# EasyEDA Pro project ProProject_Avaota Pi A_2024-03-25.epro, board 点位 (continued)
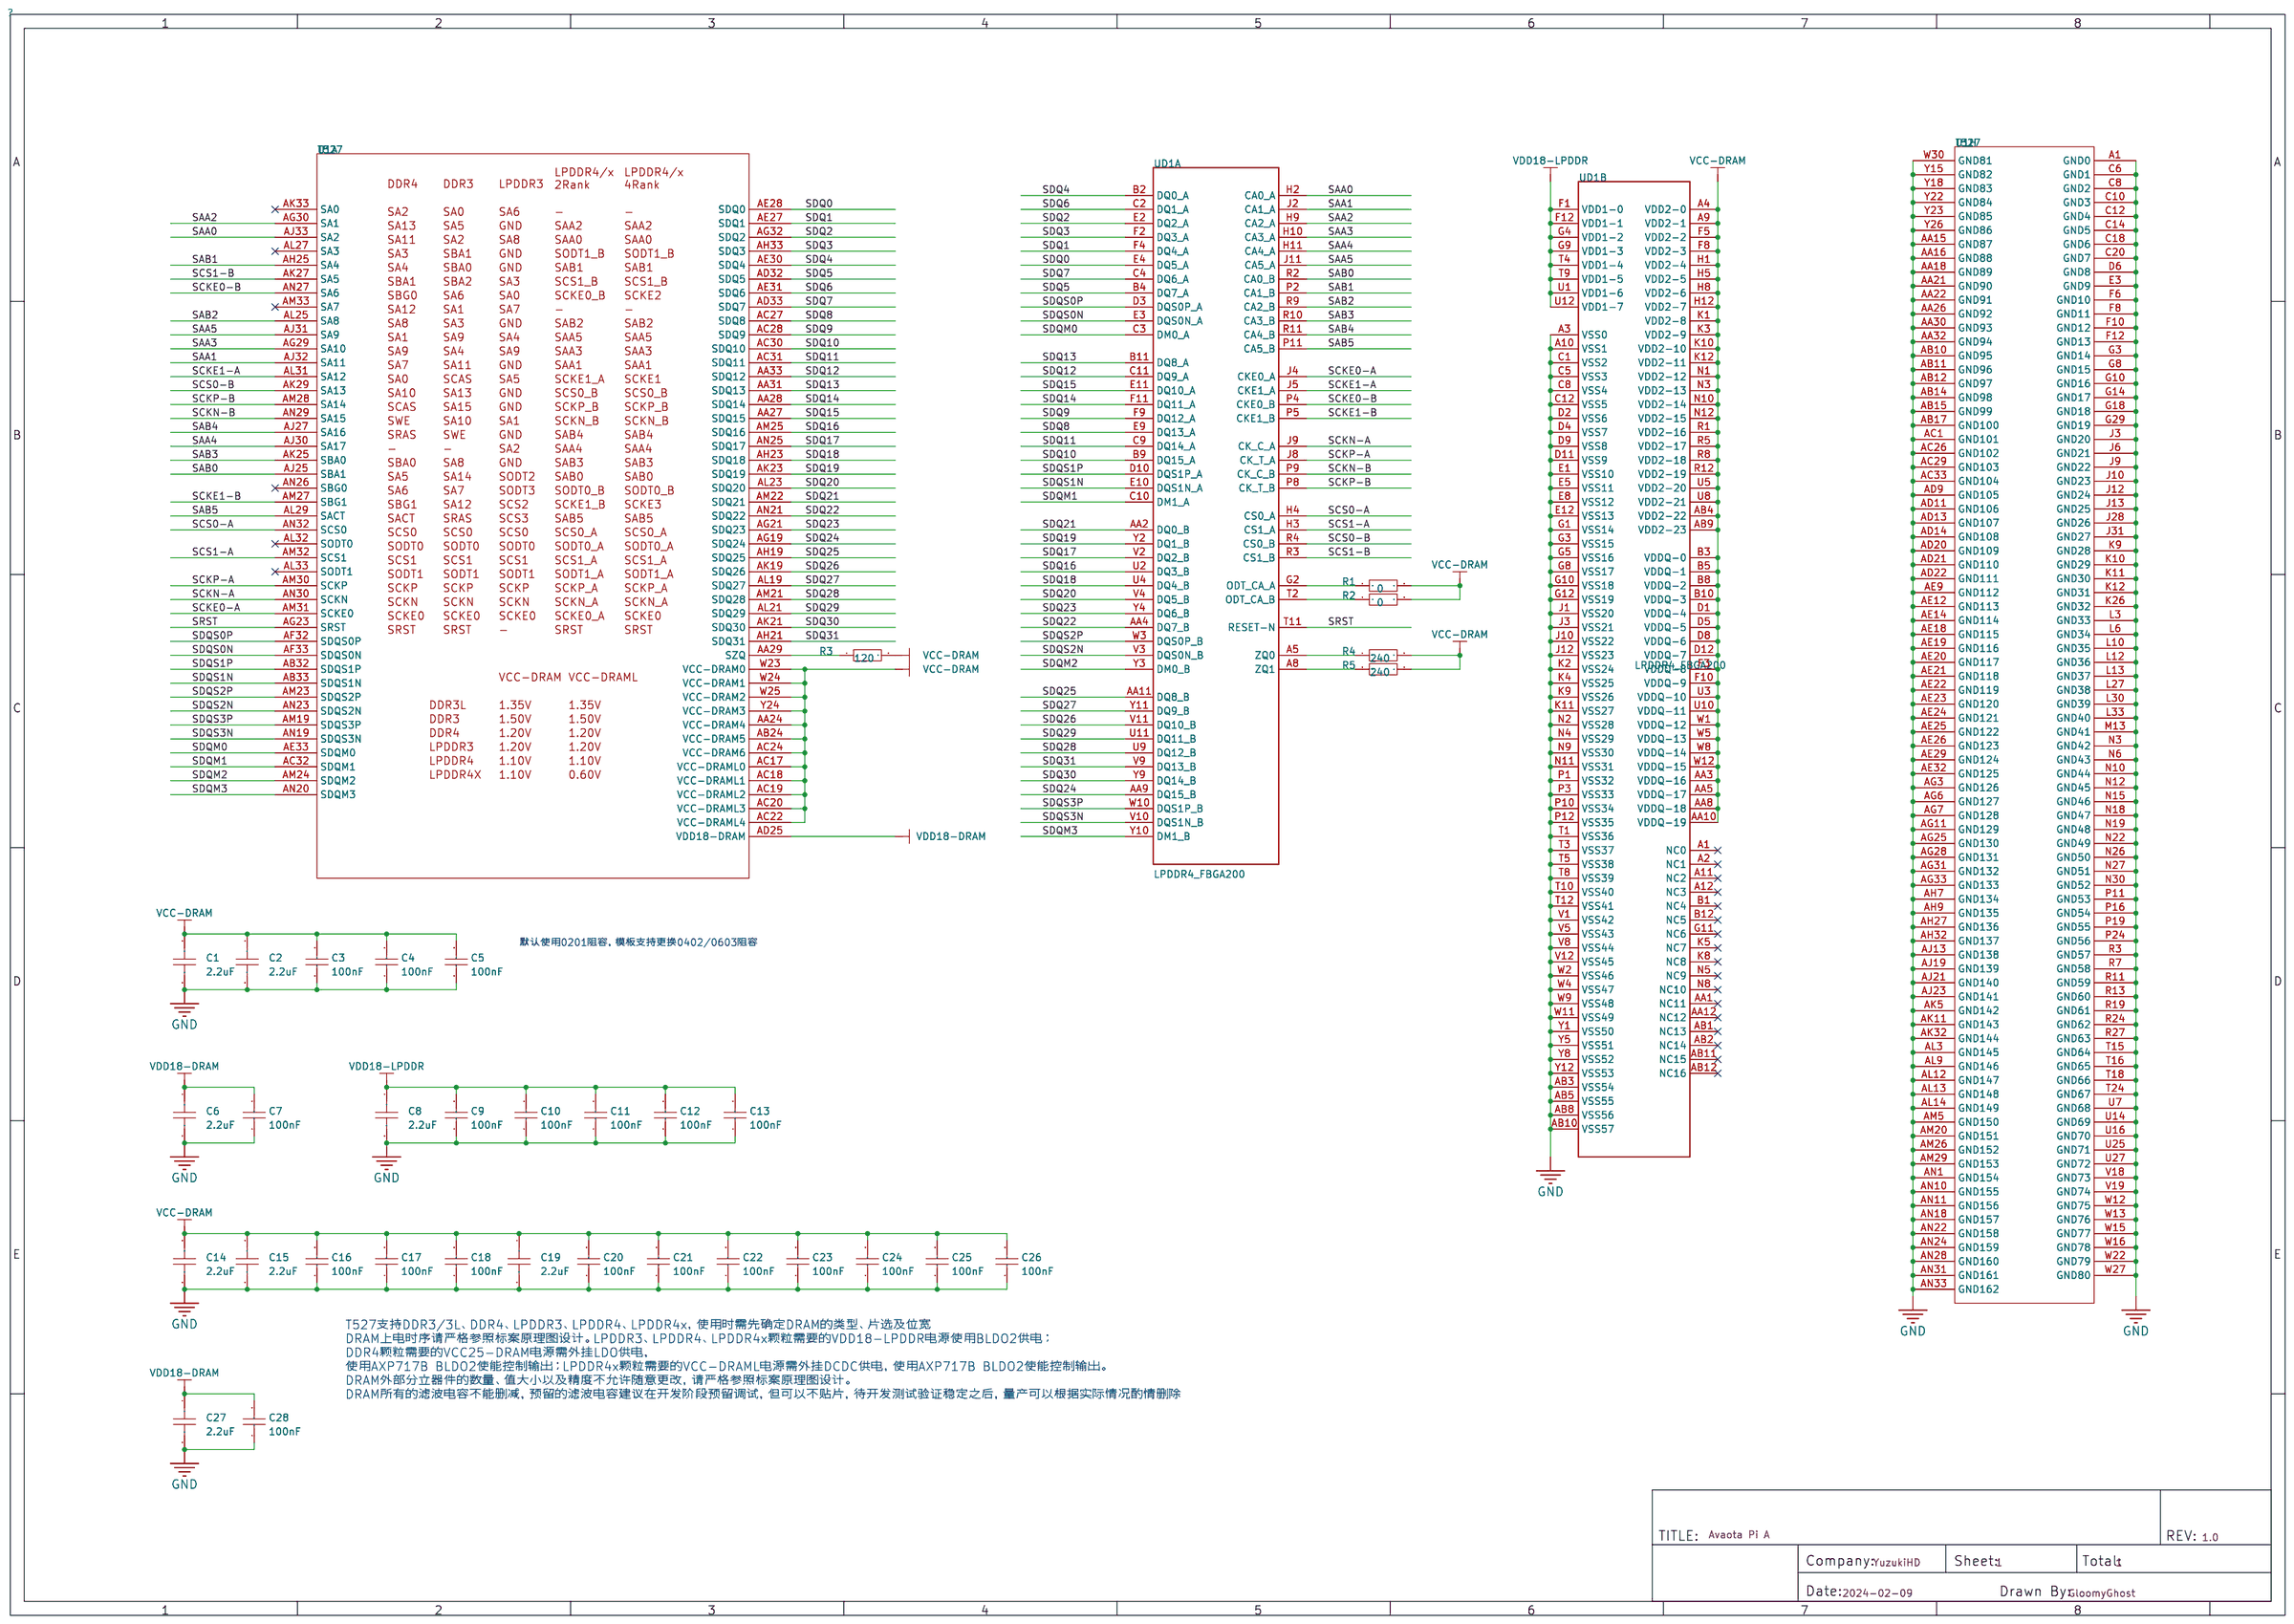
[diagram p0: schematic sheet]
## Nets (continued)
GND: C1.1 C2.1 C3.1 C5.1 C6.1 C7.1 C8.1 C10.2 C11.2 C12.2 C13.2 C14.2 C15.1 C16.1 C17.2 C18.1 C19.2 C20.2 C21.2 C22.2 C23.2 C24.2 C25.1 C26.2 C27.1 C28.1 C29.2 C30.2 C31.1 C32.2 C33.1 C34.2 C35.1 C36.2 C37.2 C38.2 C39.2 C40.2 C41.2 C42.2 C43.2 C44.1 C45.1 C46.2 C47.2 C48.2 C49.2 C50.2 C51.2 C52.2 C53.2 C54.2 C55.2 C56.1 C57.2 C58.2 C59.2 C60.1 C61.2 C62.1 C63.2 C64.1 C65.2 C66.1 C67.2 C68.2 C69.2 C70.1 C71.2 C72.1 C73.2 C74.1 C75.2 C76.2 C77.2 C78.2 C79.1 C80.1 C81.1 C82.1 C83.2 C84.2 C85.2 C86.2 C87.1 C88.2 C89.1 C90.1 C91.1 C92.1 C93.1 C94.1 C95.1 C96.1 C97.1 C98.1 C99.1 C100.1 C101.1 C102.1 C103.1 C104.1 C105.1 C106.1 C107.1 C112.1 C113.1 C114.1 C115.1 C116.2 C117.2 C118.1 C119.1 C120.1 C121.1 C122.1 C123.1 C124.1 C125.1 C126.1 C127.1 C128.1 C129.1 C130.1 C131.1 C132.2 C133.1 C134.2 C135.1 C136.1 C137.1 C138.1 C139.1 C140.1 C141.1 C142.2 C143.2 C144.1 C145.1 C146.1 C147.2 C148.1 C149.1 C150.1 C151.1 C152.1 C153.1 C154.1 C155.1 C156.1 C157.1 C158.1 C159.1 C160.1 C161.2 C162.1 C163.1 C164.1 C165.1 C166.1 C167.1 C168.1 C169.1 C170.1 C171.1 C172.1 C173.1 C174.1 C175.1 C176.1 C177.1 C178.1 C179.1 C180.1 C181.1 C182.1 C183.1 C184.1 C185.1 C186.1 C187.1 C188.1 C189.1 C200.1 C201.1 C202.1 C204.1 C208.1 C209.1 C210.1 C211.1 C213.1 C214.1 C215.1 C216.1 C218.1 C221.1 C222.1 C223.1 C224.1 C225.2 C226.1 C227.1 C228.2 C229.1 C230.1 C231.2 C232.1 C233.1 C234.2 C235.1 C236.1 C237.1 C240.1 C244.1 C245.1 C246.1 C247.1 C248.1 C249.2 C250.2 C251.1 C252.1 C253.2 C254.2 C255.1 C256.2 C257.1 C258.2 C259.1 C260.2 C261.2 C262.2 C263.2 C264.2 C265.2 C266.2 C267.2 C268.1 C269.2 C270.2 C271.2 C272.2 C273.2 C274.2 C275.1 C276.2 C277.1 C280.1 C281.1 C282.1 C283.1 C284.1 C285.1 C286.1 C287.1 C288.1 C289.1 C290.1 C291.1 C292.1 C293.1 C294.1 CGQ1.1 CGQ1.2 CN1.2 CN1.3 CN1.4 CN3.3 CN3.4 D2.1 D4.1 D5.3 D5.8 D6.3 D6.8 D8.3 D8.8 D10.3 D10.8 D11.3 D11.8 D12.3 D12.8 D13.3 D13.8 D14.3 D14.8 D15.3 D15.8 D16.2 D17.1 D18.2 D19.1 D20.2 D21.1 D22.2 D23.1 D24.1 D25.1 D26.1 D27.1 D30.1 D31.1 DC1.2 DC1.3 FPC1.5 FPC1.6 FPC1.31 FPC1.39 FPC1.44 FPC1.50 FPC1.51 FPC1.52 FPC2.5 FPC2.8 FPC2.11 FPC2.14 FPC2.17 FPC2.20 FPC2.23 FPC2.25 FPC2.29 FPC2.30 FPC2.31 FPC2.32 H1.6 H1.9 H1.14 H1.20 H1.25 H1.30 H1.34 H1.39 LED1.2 LED2.2 LED3.2 LED4.2 LED5.2 NOREF.54 NOREF#2.54 NOREF#3.54 NOREF#4.54 NOREF#5.54 R2.1 R6.1 R7.2 R8.1 R13.1 R28.1 R33.1 R34.1 R35.1 R44.1 R45.2 R46.1 R49.1 R55.1 R56.1 R57.1 R59.1 R60.1 R62.1 R67.1 R68.1 R76.2 R82.1 R85.1 R86.1 R93.1 R94.1 R95.1 R96.1 R100.1 R103.1 R104.1 R111.1 R112.1 R113.1 R114.1 R115.1 R116.2 R117.2 R118.1 R119.1 R121.1 R122.1 R129.1 R130.1 RF1.2 RF1.3 RJ1.P10 RJ1.SHIELD0 RJ1.SHIELD1 RJ2.P10 RJ2.SHIELD0 RJ2.SHIELD1 SIM1.6 SIM1.9 SIM1.10 SIM1.12 SIM1.13 SIM1.14 SW1.1 SW1.2 SW1.3 SW2.1 SW2.2 SW2.3 SW3.1 SW3.2 SW3.3 TFT1.8 TFT1.11 TFT1.13 U1.2 U2.2 U3.7 U3.9 U4.8 U4.53 U5.9 U5.21 U8.A6 U8.C4 U8.E7 U8.G5 U8.H10 U8.J5 U8.K8 U8.N2 U8.N5 U8.P4 U8.P6 U9.1 U9.3 U9.20 U9.31 U9.33 U9.36 U11.2 U12.41 U13.41 U14.A1 U14.A32 U14.A33 U14.AA7 U14.AA15 U14.AA16 U14.AA18 U14.AA21 U14.AA22 U14.AA26 U14.AA30 U14.AA32 U14.AB10 U14.AB11 U14.AB12 U14.AB14 U14.AB15 U14.AB17 U14.AC1 U14.AC26 U14.AC29 U14.AC33 U14.AD9 U14.AD11 U14.AD13 U14.AD14 U14.AD20 U14.AD21 U14.AD22 U14.AE9 U14.AE12 U14.AE14 U14.AE18 U14.AE19 U14.AE20 U14.AE21 U14.AE22 U14.AE23 U14.AE24 U14.AE25 U14.AE26 U14.AE29 U14.AE32 U14.AG3 U14.AG6 U14.AG7 U14.AG11 U14.AG25 U14.AG28 U14.AG31 U14.AG33 U14.AH7 U14.AH9 U14.AH27 U14.AH32 U14.AJ13 U14.AJ19 U14.AJ21 U14.AJ23 U14.AK5 U14.AK11 U14.AK32 U14.AL3 U14.AL9 U14.AL12 U14.AL13 U14.AL14 U14.AM5 U14.AM20 U14.AM26 U14.AM29 U14.AN1 U14.AN10 U14.AN11 U14.AN18 U14.AN22 U14.AN24 U14.AN28 U14.AN31 U14.AN33 U14.B21 U14.C6 U14.C8 U14.C10 U14.C12 U14.C14 U14.C18 U14.C20 U14.C21 U14.C22 U14.C24 U14.C26 U14.C28 U14.C30 U14.C31 U14.D6 U14.E3 U14.E29 U14.F6 U14.F8 U14.F10 U14.F12 U14.F22 U14.F24 U14.G3 U14.G8 U14.G10 U14.G14 U14.G18 U14.G26 U14.G28 U14.G29 U14.H24 U14.J3 U14.J6 U14.J9 U14.J10 U14.J12 U14.J13 U14.J17 U14.J21 U14.J22 U14.J23 U14.J26 U14.J28 U14.J31 U14.K9 U14.K10 U14.K11 U14.K12 U14.K15 U14.K16 U14.K21 U14.K22 U14.K24 U14.K25 U14.K26 U14.L3 U14.L6 U14.L10 U14.L12 U14.L13 U14.L16 U14.L19 U14.L24 U14.L27 U14.L30 U14.L33 U14.M13 U14.M16 U14.M18 U14.M19 U14.N3 U14.N6 U14.N10 U14.N12 U14.N15 U14.N18 U14.N19 U14.N22 U14.N26 U14.N27 U14.N30 U14.P11 U14.P16 U14.P19 U14.P24 U14.R3 U14.R7 U14.R11 U14.R13 U14.R19 U14.R24 U14.R27 U14.T15 U14.T16 U14.T18 U14.T24 U14.U7 U14.U14 U14.U16 U14.U25 U14.U27 U14.V18 U14.V19 U14.W12 U14.W13 U14.W15 U14.W16 U14.W22 U14.W27 U14.W30 U14.Y10 U14.Y15 U14.Y18 U14.Y22 U14.Y23 U14.Y26 U15.2 U15.5 U15.8 U15.11 U15.16 U15.19 U15.21 U15.22 U15.23 U15.24 U16.2 U17.2 U18.4 U18.9 UD1.A3 UD1.A10 UD1.AB3 UD1.AB5 UD1.AB8 UD1.AB10 UD1.C1 UD1.C5 UD1.C8 UD1.C12 UD1.D2 UD1.D4 UD1.D9 UD1.D11 UD1.E1 UD1.E5 UD1.E8 UD1.E12 UD1.G1 UD1.G3 UD1.G5 UD1.G8 UD1.G10 UD1.G12 UD1.J1 UD1.J3 UD1.J10 UD1.J12 UD1.K2 UD1.K4 UD1.K9 UD1.K11 UD1.N2 UD1.N4 UD1.N9 UD1.N11 UD1.P1 UD1.P3 UD1.P10 UD1.P12 UD1.T1 UD1.T3 UD1.T5 UD1.T8 UD1.T10 UD1.T12 UD1.V1 UD1.V5 UD1.V8 UD1.V12 UD1.W2 UD1.W4 UD1.W9 UD1.W11 UD1.Y1 UD1.Y5 UD1.Y8 UD1.Y12 USB1.2 USB1.5 USB1.8 USB1.11 USB1.14 USB1.17 USB1.20 USB2.4 USB2.7 USB2.13 USB2.16 USB2.19 USB2.20 USB2.21 USB2.22 USB3.12 USB3.13 USB3.14 USB3.15 USB3.A1B12 USB3.B1A12 X1.2 X1.4 X3.2 X3.4 X4.2 X4.4
VBUS: C27.2 C28.2 C221.2 C222.2 C246.2 C247.2 C280.2 C294.2 D1.2 D3.2 D9.2 FPC1.1 FPC1.2 H1.2 H1.4 LED2.4 LED3.4 LED4.4 LED5.4 R52.1 R53.1 U4.49 U4.50 U11.3 U17.5 USB2.1 USB2.10
VBUS-USB: C281.2 C282.2 R120.2 U17.1 USB3.A4B9 USB3.B4A9
VCC-3V3-BLK: C277.2 R126.2 U16.1
VCC-LDO-RTC: C45.2 C92.2 R9.1 R10.1 U4.35 U14.AE13
VDD-CPUBFB: U5.1 U5.16 U14.R22
VDD-CPULFB: U4.12 U14.AA19
VDD-DNRFB: U5.4 U14.AB13
VDD-SYSFB: U4.34 U14.P18
323-ALDO1: C69.1 U5.15
323-DCDC1/2: C19.1 C20.1 C21.1 C22.1 C23.1 C24.1 C72.2 C74.2 C80.2 C81.2 L6.2 L7.2 U14.T19 U14.T21 U14.T22 U14.U18 U14.U19 U14.U21 U14.U22
323-DCDC3: C83.1 C84.1 C85.1 C86.1 C87.2 C89.2 L8.2 U14.AA12 U14.AA13 U14.Y12 U14.Y13
323-DLDO1: C71.1 U5.12
323-RTCLDO: C73.1 U5.7
ADCIN0: C106.2 R26.2 U14.W9
ADCIN1: C107.2 R27.2 U14.W10
ALDO1: C51.1 U4.13
ALDO2: C52.1 U4.14
ALDO3: C53.1 C181.2 C182.2 C183.2 C184.2 R11.1 R12.1 U4.16 U14.AE11 U14.AG9
ALDO4: C54.1 C90.2 C93.2 C108.2 C114.2 C132.1 C133.2 C161.1 C162.2 R19.2 R20.2 R24.2 R30.2 R31.2 R32.2 U4.17 U14.AB9 U14.AD15 U14.AD25 U14.AG15 U14.W7
ALDO-OUT: C103.2 U14.AE7
AP-NMI: C94.2 R10.2 U4.37 U5.11 U14.AM10
AP-RESET: C95.2 R9.2 R21.2 U4.1 U5.13 U14.AJ11
AP-WAKE-BT: R69.2 U9.6 U14.U4
AXP717-CC1: D24.2 R130.2 USB3.A5
AXP717-CC2: D31.2 R129.2 USB3.B5
BLDO1: C59.1 C165.2 C166.2 C171.2 C172.2 C179.2 C180.2 R17.2 R69.1 R70.1 U4.18 U9.22 U14.N9 U14.N24 U14.T9
BLDO2: C61.1 C134.1 C135.2 C136.2 C137.2 C138.2 C139.2 C140.2 C141.2 U4.19 U5.14 UD1.F1 UD1.F12 UD1.G4 UD1.G9 UD1.T4 UD1.T9 UD1.U1 UD1.U12
BLDO3: C63.1 C104.2 C185.2 C186.2 C187.2 C188.2 C201.2 C202.2 C208.2 C209.2 R127.1 R128.1 U4.21 U14.AJ5 U14.J15 U14.K13 U14.L22 U14.M10 U14.M21
BLDO4: C65.1 U4.22
BOOT-SEL-ADC: R30.1 R33.2 U14.W1
BT-RESETN: U9.34 U14.U3
BT-WAKE-AP: R70.2 U9.7 U14.U5
CAN-RX0: U11.4 U14.AJ17
CAN-TX0: U11.1 U14.AH17
CLDO1: C60.2 C163.2 C164.2 C225.1 C226.2 C227.2 U4.23 U8.C6 U8.M4 U8.N4 U8.P3 U8.P5 U14.U26
CLDO2: C62.2 C91.2 U4.24 U14.R26
CLDO4: C66.2 U4.27
CPUSLDO: C13.1 C14.1 C35.2 U4.28 U14.AC15
CPUX-RX: D30.2 H1.10 U14.R29 USB3.B8
CPUX-TX: D27.2 H1.8 U14.R28 USB3.A8
CPVDD: C105.2 U14.AJ3
CPVEE: C115.2 U14.AJ4 U14.AK2
CTP-INT: FPC1.35 U14.R31
CTP-RST: FPC1.36 U14.R30
CTP-SCK: FPC1.37 U14.R32
CTP-SDA: FPC1.38 U14.R33
DCDC1: C15.2 C16.2 C36.1 C37.1 C38.1 C39.1 C40.1 C41.1 C288.2 C289.2 L2.2 U14.W19 U14.W21 U14.Y19 U14.Y21
DCDC2: C18.2 C25.2 C47.1 C48.1 C49.1 C50.1 C57.1 C58.1 C67.1 C68.1 C75.1 C76.1 C77.1 C78.1 C210.2 C211.2 C213.2 C214.2 C215.2 C216.2 C218.2 C290.2 C291.2 L3.2 U14.J16 U14.L18 U14.L21 U14.M22 U14.N13 U14.N21 U14.P13 U14.P21 U14.P22 U14.R15 U14.R17 U14.R18 U14.T11 U14.T13 U14.U12 U14.U13
DCDC3: C31.2 C33.2 C116.1 C117.1 C118.2 C119.2 C120.2 C121.2 C122.2 C123.2 C124.2 C125.2 C126.2 C127.2 C128.2 C129.2 C130.2 C131.2 C142.1 C143.1 C144.2 C145.2 C146.2 C147.1 C148.2 C149.2 C150.2 C151.2 C152.2 C153.2 C154.2 C155.2 C156.2 C157.2 C158.2 C159.2 C160.2 C292.2 C293.2 L4.2 R36.2 R37.2 R38.2 R39.2 R40.2 U4.29 U14.AA24 U14.AB24 U14.AC17 U14.AC18 U14.AC19 U14.AC20 U14.AC22 U14.AC24 U14.W23 U14.W24 U14.W25 U14.Y24 UD1.A4 UD1.A9 UD1.AA3 UD1.AA5 UD1.AA8 UD1.AA10 UD1.AB4 UD1.AB9 UD1.B3 UD1.B5 UD1.B8 UD1.B10 UD1.D1 UD1.D5 UD1.D8 UD1.D12 UD1.F3 UD1.F5 UD1.F8 UD1.F10 UD1.H1 UD1.H5 UD1.H8 UD1.H12 UD1.K1 UD1.K3 UD1.K10 UD1.K12 UD1.N1 UD1.N3 UD1.N10 UD1.N12 UD1.R1 UD1.R5 UD1.R8 UD1.R12 UD1.U3 UD1.U5 UD1.U8 UD1.U10 UD1.W1 UD1.W5 UD1.W8 UD1.W12
DCDC4: C32.1 C34.1 C42.1 C167.2 C168.2 C169.2 C170.2 C175.2 C176.2 C177.2 C178.2 C200.2 C204.2 C223.2 C224.2 C250.1 C258.1 C262.1 C263.1 C264.1 C269.1 C270.1 C271.1 C276.1 FPC1.3 FPC1.4 FPC2.2 FPC2.3 FPC2.4 H1.1 H1.17 L5.1 R14.1 R61.1 R81.2 R84.2 R88.1 R90.1 R92.2 R99.2 R102.2 R106.1 R108.1 R110.2 R124.2 R125.2 RJ1.11 RJ1.14 RJ2.11 RJ2.14 TFT1.10 U9.9 U11.5 U12.11 U12.29 U12.40 U13.11 U13.29 U13.40 U14.AE16 U14.J18 U14.J19 U14.K19 U14.L9 U14.L17 U14.L26 U14.P9 U15.20 U16.5
DCIN-5V: C5.2 C6.2 D3.1 L1.2 R3.2
DCIN-12V: C1.2 C2.2 C7.2 Q1.2 R1.2 R4.2 U1.1 U2.1 U3.2
DCXO-XIN: C99.2 U14.AM13 X1.1
DCXO-XOUT: C98.2 U14.AN13 X1.3
DDR-PARA-SEL-ADC1: R31.1 R34.2 U14.W2
DDR-PARA-SEL-ADC2: R32.1 R35.2 U14.W3
DSP-UART-RX: H1.40 U14.AN2
DSP-UART-TX: H1.37 U14.AN3
EDP-AUXN: C199.1 U14.C33
EDP-AUXP: C198.1 U14.C32
EDP-HPD: D12.4 D12.7 R60.2 U14.C29 U15.18
EDP-TX0N: C196.1 U14.B29
EDP-TX0P: C197.1 U14.A29
EDP-TX1N: C194.1 U14.B30
EDP-TX1P: C195.1 U14.A30
EDP-TX2N: C192.1 U14.B31
EDP-TX2P: C193.1 U14.A31
EDP-TX3N: C190.1 U14.B33
EDP-TX3P: C191.1 U14.B32
EMMC-VDDI: C231.1 C232.2 C233.2 U8.C2
FEL: C96.2 R22.2 U14.F16
GM0_DVDD10: C253.1 C254.1 C265.1 C266.1 C267.1 C268.2 L9.2 U12.3 U12.8 U12.21 U12.38
GM0_INTB: R88.2 U12.31
GM0_LED0: R87.2 R92.1 U12.32
GM0_LED1: R80.2 R84.1 R87.1 R94.2 U12.33
GM0_LED2: R79.1 R81.1 R96.2 U12.34
GM0_MDIN0: RJ1.P3 U12.2
GM0_MDIN1: RJ1.P7 U12.5
GM0_MDIN2: RJ1.P6 U12.7
GM0_MDIN3: RJ1.P9 U12.10
GM0_MDIP0: RJ1.P2 U12.1
GM0_MDIP1: RJ1.P4 U12.4
GM0_MDIP2: RJ1.P5 U12.6
GM0_MDIP3: RJ1.P8 U12.9
GM0_REGOUT: L9.1 U12.30
GM0_RSET: R85.2 U12.39
GM0_XTAL_IN: C252.2 U12.36 X3.1
GM0_XTAL_OUT: C251.2 U12.37 X3.3
GM1_DVDD10: C260.1 C261.1 C272.1 C273.1 C274.1 C275.2 L10.2 U13.3 U13.8 U13.21 U13.38
GM1_DVDDRG: C64.2 C102.2 C173.2 C174.2 C228.1 C229.2 C230.2 C234.1 C235.2 C236.2 C249.1 C256.1 D20.1 R47.1 R73.2 R74.2 R75.2 R83.1 R89.2 R91.2 R101.1 R107.2 R109.2 SIM1.4 U4.26 U8.E6 U8.F5 U8.J10 U8.K9 U12.28 U13.28 U14.AC9 U14.L15 U18.8
GM1_INTB: R106.2 U13.31
GM1_LED0: R105.2 R110.1 U13.32
GM1_LED1: R98.2 R102.1 R105.1 R112.2 U13.33
GM1_LED2: R97.1 R99.1 R114.2 U13.34
GM1_MDIN0: RJ2.P3 U13.2
GM1_MDIN1: RJ2.P7 U13.5
GM1_MDIN2: RJ2.P6 U13.7
GM1_MDIN3: RJ2.P9 U13.10
GM1_MDIP0: RJ2.P2 U13.1
GM1_MDIP1: RJ2.P4 U13.4
GM1_MDIP2: RJ2.P5 U13.6
GM1_MDIP3: RJ2.P8 U13.9
GM1_REGOUT: L10.1 U13.30
GM1_RSET: R103.2 U13.39
GM1_XTAL_IN: C259.2 U13.36 X4.1
GM1_XTAL_OUT: C257.2 U13.37 X4.3
HBIAS: C237.2 R64.2 U14.AL1
HCEC: D7.1 R48.1 U14.E28
HHPD: C189.2 R54.1 U14.D28
HP-DET: CN2.3 U14.AJ2
HPOUTFB: C239.1 CN2.6 R66.2 R122.2 U14.AM1
HPOUTL: C243.1 CN2.5 U14.AL2
HPOUTR: C242.1 CN2.2 U14.AM2
HREXT: R59.2 U14.F26
HS-MIC: C239.2 C240.2 CN2.4 R64.1 R65.2
HSCL: R50.1 U14.D26
HSDA: R51.1 U14.E26
HTX0N: D6.2 D6.9 U14.C27 USB1.9
HTX0P: D6.1 D6.10 U14.B27 USB1.7
HTX1N: D5.5 D5.6 U14.B26 USB1.6
HTX1P: D5.4 D5.7 U14.A26 USB1.4
HTX2N: D5.2 D5.9 U14.C25 USB1.3
HTX2P: D5.1 D5.10 U14.B25 USB1.1
HTXCN: D6.5 D6.6 U14.B28 USB1.12
HTXCP: D6.4 D6.7 U14.A28 USB1.10
IR-RX: CGQ1.3 R124.1 U14.AL16
LCD0-CLK: FPC1.43 U14.K31
LCD0-D0: FPC1.7 U14.N28
LCD0-D1: FPC1.8 U14.N29
LCD0-D2: FPC1.9 U14.D32
LCD0-D3: FPC1.10 U14.D33
LCD0-D4: FPC1.11 U14.E30
LCD0-D5: FPC1.12 U14.E31
LCD0-D6: FPC1.13 U14.E32
LCD0-D7: FPC1.14 U14.E33
LCD0-D8: FPC1.15 U14.M31
LCD0-D9: FPC1.16 U14.M32
LCD0-D10: FPC1.17 U14.F32
LCD0-D11: FPC1.18 U14.F33
LCD0-D12: FPC1.19 U14.G30
LCD0-D13: FPC1.20 U14.G31
LCD0-D14: FPC1.21 U14.G32
LCD0-D15: FPC1.22 U14.G33
LCD0-D16: FPC1.23 U14.P31
LCD0-D17: FPC1.24 U14.P32
LCD0-D18: FPC1.25 U14.H31
LCD0-D19: FPC1.26 U14.H32
LCD0-D20: FPC1.27 U14.J29
LCD0-D21: FPC1.28 U14.J30
LCD0-D22: FPC1.29 U14.J32
LCD0-D23: FPC1.30 U14.J33
LCD0-DE: FPC1.40 U14.K32
LCD0-HSYNC: FPC1.42 U14.L28
LCD0-PWM: FPC1.32 U14.L31
LCD0-RST: FPC1.33 U14.L32
LCD0-VSYNC: FPC1.41 U14.L29
LEDC: LED2.3 U14.C13
MCSI0-CKN: FPC2.12 U14.A10
MCSI0-CKP: FPC2.13 U14.B10
MCSI0-D0N: FPC2.6 U14.A12
MCSI0-D0P: FPC2.7 U14.B12
MCSI0-D1N: FPC2.9 U14.B11
MCSI0-D1P: FPC2.10 U14.C11
MCSI0-D2N: FPC2.15 U14.E12
MCSI0-D2P: FPC2.16 U14.D12
MCSI0-D3N: FPC2.18 U14.E10
MCSI0-D3P: FPC2.19 U14.D10
MCSI0-MCLK: FPC2.24 U14.A6
MCSI0-PWDN: FPC2.28 U14.B4
MCSI0-RSTN: FPC2.27 U14.A4
MCSI0-SCK: FPC2.21 R127.2 U14.E8
MCSI0-SDA: FPC2.22 R128.2 U14.D8
MCSI0-USER: FPC2.26 U14.B5
MICIN3N: C241.1 U14.AF1
MICIN3P: C238.1 U14.AF2
PE0: H1.12 U14.E6
PE1: H1.21 U14.C4
PE2: H1.13 U14.E5
PE3: H1.16 U14.E4
PE4: H1.15 U14.C3
PE5: H1.22 U14.B3
PE6: H1.19 U14.A3
PE7: H1.24 U14.A2
PE8: H1.23 U14.B2
PE9: H1.18 U14.B1
PE10: H1.27 U14.C2
PE11: H1.7 U14.J7
PE12: H1.26 U14.C1
PE13: H1.11 U14.G6
PE14: H1.5 U14.L7
PE15: H1.3 U14.N7
PGAOUT0: R26.1 U14.U8
PGAOUT1: R27.1 U14.U10
PHYRSTB0: R90.2 U12.12 U14.D16
PHYRSTB1: R108.2 U13.12 U14.J1
PMU-SCK: R11.2 U4.52 U5.6 U14.AN6
PMU-SDA: R12.2 U4.51 U5.5 U14.AN5
PS: C12.1 C17.1 C26.1 C29.1 C30.1 C46.1 C55.1 C56.2 C70.2 C79.2 C82.2 C283.2 C284.2 C285.2 C286.2 C287.2 U4.9 U4.15 U4.20 U4.25 U4.31 U4.32 U4.43 U4.44 U4.47 U4.48 U5.2 U5.17 U5.20
PWRON: C11.1 C97.2 R23.2 U4.6
RF: C244.2 R72.1 U9.2
RGMII0-CLKIN: U12.35 U14.C17
RGMII0-MDC: U12.13 U14.C16
RGMII0-MDIO: R83.2 U12.14 U14.B16
RGMII0-RXCK: R93.2 U12.27 U14.B14
RGMII0-RXCTL: R95.2 U12.26 U14.D18
RGMII0-RXD0: R89.1 U12.25 U14.E18
RGMII0-RXD1: R86.2 U12.24 U14.F18
RGMII0-RXD2: R82.2 U12.23 U14.D14
RGMII0-RXD3: R91.1 U12.22 U14.E14
RGMII0-TXCK: U12.20 U14.G12
RGMII0-TXCTL: U12.19 U14.F14
RGMII0-TXD0: U12.18 U14.E16
RGMII0-TXD1: U12.17 U14.B17
RGMII0-TXD2: U12.16 U14.A14
RGMII0-TXD3: U12.15 U14.B13
RGMII1-CLKIN: U13.35 U14.E2
RGMII1-MDC: U13.13 U14.H2
RGMII1-MDIO: R101.2 U13.14 U14.H3
RGMII1-RXCK: R111.2 U13.27 U14.J5
RGMII1-RXCTL: R113.2 U13.26 U14.E1
RGMII1-RXD0: R107.1 U13.25 U14.D2
RGMII1-RXD1: R104.2 U13.24 U14.D1
RGMII1-RXD2: R100.2 U13.23 U14.J4
RGMII1-RXD3: R109.1 U13.22 U14.G5
RGMII1-TXCK: U13.20 U14.G1
RGMII1-TXCTL: U13.19 U14.G2
RGMII1-TXD0: U13.18 U14.F2
RGMII1-TXD1: U13.17 U14.F1
RGMII1-TXD2: U13.16 U14.L5
RGMII1-TXD3: U13.15 U14.L4
SAA0: U14.AJ33 UD1.H2
SAA1: U14.AJ32 UD1.J2
SAA2: U14.AG30 UD1.H9
SAA3: U14.AG29 UD1.H10
SAA4: U14.AJ30 UD1.H11
SAA5: U14.AJ31 UD1.J11
SAB0: U14.AJ25 UD1.R2
SAB1: U14.AH25 UD1.P2
SAB2: U14.AL25 UD1.R9
SAB3: U14.AK25 UD1.R10
SAB4: U14.AJ27 UD1.R11
SAB5: U14.AL29 UD1.P11
SCKE0-A: U14.AM31 UD1.J4
SCKE0-B: U14.AN27 UD1.P4
SCKE1-A: U14.AL31 UD1.J5
SCKE1-B: U14.AM27 UD1.P5
SCKN-A: U14.AN30 UD1.J9
SCKN-B: U14.AN29 UD1.P9
SCKP-A: U14.AM30 UD1.J8
SCKP-B: U14.AM28 UD1.P8
SCS0-A: U14.AN32 UD1.H4
SCS0-B: U14.AK29 UD1.R4
SCS1-A: U14.AM32 UD1.H3
SCS1-B: U14.AK27 UD1.R3
SDC0-CLK: D19.2 R42.2 SIM1.5
SDC0-CMD: D21.2 SIM1.3 U14.B19
SDC0-D0: D18.1 SIM1.7 U14.A20
SDC0-D1: D17.2 SIM1.8 U14.B20
SDC0-D2: D23.2 SIM1.1 U14.A18
SDC0-D3: D22.1 SIM1.2 U14.B18
SDC0-DET: R63.1 U14.D20
SDC1-CLK: R43.2 U9.17
SDC1-CMD: U9.16 U14.R2
SDC1-D0: U9.18 U14.P3
SDC1-D1: U9.19 U14.P2
SDC1-D2: U9.14 U14.T3
SDC1-D3: U9.15 U14.T2
SDC2-CLK: R41.1 U8.M6
SDC2-CMD: U8.M5 U14.W33
SDC2-D0: U8.A3 U14.V32
SDC2-D1: U8.A4 U14.U32
SDC2-D2: U8.A5 U14.T32
SDC2-D3: U8.B2 U14.W32
SDC2-D4: U8.B3 U14.W31
SDC2-D5: U8.B4 U14.V31
SDC2-D6: U8.B5 U14.U31
SDC2-D7: U8.B6 U14.T31
SDC2-DS: U8.H5 U14.W28
SDC2-RST: U8.K5 U14.Y31
SDQ0: U14.AE28 UD1.E4
SDQ1: U14.AE27 UD1.F4
SDQ2: U14.AG32 UD1.E2
SDQ3: U14.AH33 UD1.F2
SDQ4: U14.AE30 UD1.B2
SDQ5: U14.AD32 UD1.B4
SDQ6: U14.AE31 UD1.C2
SDQ7: U14.AD33 UD1.C4
SDQ8: U14.AC27 UD1.E9
SDQ9: U14.AC28 UD1.F9
SDQ10: U14.AC30 UD1.B9
SDQ11: U14.AC31 UD1.C9
SDQ12: U14.AA33 UD1.C11
SDQ13: U14.AA31 UD1.B11
SDQ14: U14.AA28 UD1.F11
SDQ15: U14.AA27 UD1.E11
SDQ16: U14.AM25 UD1.U2
SDQ17: U14.AN25 UD1.V2
SDQ18: U14.AH23 UD1.U4
SDQ19: U14.AK23 UD1.Y2
SDQ20: U14.AL23 UD1.V4
SDQ21: U14.AM22 UD1.AA2
SDQ22: U14.AN21 UD1.AA4
SDQ23: U14.AG21 UD1.Y4
SDQ24: U14.AG19 UD1.AA9
SDQ25: U14.AH19 UD1.AA11
SDQ26: U14.AK19 UD1.V11
SDQ27: U14.AL19 UD1.Y11
SDQ28: U14.AM21 UD1.U9
SDQ29: U14.AL21 UD1.U11
SDQ30: U14.AK21 UD1.Y9
SDQ31: U14.AH21 UD1.V9
SDQM0: U14.AE33 UD1.C3
SDQM1: U14.AC32 UD1.C10
SDQM2: U14.AM24 UD1.Y3
SDQM3: U14.AN20 UD1.Y10
SDQS0N: U14.AF33 UD1.E3
SDQS0P: U14.AF32 UD1.D3
SDQS1N: U14.AB33 UD1.E10
SDQS1P: U14.AB32 UD1.D10
SDQS2N: U14.AN23 UD1.V3
SDQS2P: U14.AM23 UD1.W3
SDQS3N: U14.AN19 UD1.V10
SDQS3P: U14.AM19 UD1.W10
SPI0-CLK: R123.1 U18.6
SPI0-CS: R73.1 U14.K3 U18.1
SPI0-HOLD: R75.1 U14.N2 U18.7
SPI0-MISO: U14.L1 U18.2
SPI0-MOSI: U14.L2 U18.5
SPI0-WP: R74.1 U14.M2 U18.3
SPI-LCD-BLK: H1.32 R119.2 U14.AN9 U16.4
SPI-LCD-CLK: H1.36 TFT1.4 U14.AJ9
SPI-LCD-CS: H1.33 TFT1.7 U14.AK9
SPI-LCD-DC: H1.38 TFT1.5 U14.AJ7
SPI-LCD-MOSI: H1.35 TFT1.3 U14.AK7
SPI-LCD-RST: H1.31 TFT1.6 U14.AM9
SRST: U14.AG23 UD1.T11
STWI1-SCK: H1.28 U14.AM4
STWI1-SDA: H1.29 U14.AM3
UART1-CTS: U9.41 U14.U6
UART1-RTS: U9.44 U14.R4
UART1-RX: U9.42 U14.R5
UART1-TX: U9.43 U14.R6
USB0-DM: D26.2 U14.B24 USB3.A7 USB3.B7
USB0-DP: D25.2 U14.A24 USB3.A6 USB3.B6
USB0-DRVVBUS: R118.2 U14.AL17 U17.4
USB0-VBUSDET: R120.1 R121.2 U14.AK17
USB1-DM: D13.4 D13.7 U14.E24 USB2.2
USB1-DP: D13.5 D13.6 U14.D24 USB2.3
USB2-DM: D14.4 D14.7 U14.E22 USB2.11
USB2-DP: D14.5 D14.6 U14.D22 USB2.12
USB2-RXN: D15.1 D15.10 U14.C23 USB2.14
USB2-RXP: D15.2 D15.9 U14.B23 USB2.15
USB2-TXN: C219.1 U14.B22
USB2-TXP: C220.1 U14.A22
VCM-ADC: C112.2 U14.Y9
VRA1: C109.2 U14.AG5
VRA2: C110.2 U14.AG4
VREFP-ADC: C113.2 R24.1 U14.AA9
VRP: C111.2 U14.AC7
WL-REG-ON: U9.12 U14.U2
WL-WAKE-AP: U9.13 U14.U1
X32KIN: C100.2 R25.1 U14.AM12 X2.1
X32KOUT: C101.2 R25.2 U14.AM11 X2.2
$1N3706: L2.1 U4.10 U4.11
$1N3718: L3.1 U4.33
$1N3723: L4.1 U4.30
$1N3725: C43.1 U4.7
$1N4703: R13.2 U4.39
$1N4773: C44.2 U4.41 U4.42
$1N4806: R14.2 U4.38
$1N4992: L5.2 U4.45 U4.46
$1N6251: L6.1 U5.18
$1N6517: L7.1 U5.19
$1N6728: L8.1 U5.3
$1N7320: C88.1 U5.8
$1N42597: LED1.1 R17.1
$2N1846: R21.1 SW1.4
$2N1994: R22.1 SW2.4
$2N2360: R19.1 U14.V3
$2N2431: R20.1 U14.V2
$2N7803: R23.1 SW3.4
$3N7591: R38.1 U14.AA29
$3N7643: R39.1 UD1.A5
$3N7644: R40.1 UD1.A8
$3N7648: R36.1 UD1.G2
$3N7649: R37.1 UD1.T2
$4N500: R41.2 U14.Y32
$4N609: R42.1 U14.C19
$4N713: R43.1 U14.R1
$5N3909: R123.2 U14.K2
$6N1044: R44.2 U14.G22
$6N1104: R46.2 U14.G24
$6N1424: R55.2 U14.F28
$6N1887: R45.1 U14.G20
$6N1980: R49.2 U14.E20
$6N3848: D7.2 R47.2
$6N3980: D8.1 D8.10 R48.2 USB1.13
$6N4130: D9.1 USB1.18
$6N4341: D8.2 D8.9 R50.2 R52.2 USB1.15
$6N4352: D8.4 D8.7 R51.2 R53.2 USB1.16
$6N4414: D8.5 D8.6 R54.2 USB1.19
$6N5317: C190.2 D10.1 D10.10 U15.1
$6N5400: C191.2 D10.2 D10.9 U15.3
$6N5519: C192.2 D10.4 D10.7 U15.4
$6N5561: C193.2 D10.5 D10.6 U15.6
$6N5603: C194.2 D11.1 D11.10 U15.7
$6N5645: C195.2 D11.2 D11.9 U15.9
$6N5687: C196.2 D11.4 D11.7 U15.10
$6N5729: C197.2 D11.5 D11.6 U15.12
$6N6451: C199.2 D12.2 D12.9 R61.2 U15.17
$6N6466: C198.2 D12.1 D12.10 R62.2 U15.15
$6N6553: R57.2 U15.14
$6N6556: R56.2 U15.13
$6N19248: C220.2 D15.5 D15.6 USB2.18
$6N19249: C219.2 D15.4 D15.7 USB2.17
$6N30377: R117.1 U17.3
$8N2040: D16.1 R63.2 SIM1.11
$8N6741: LED2.1 LED3.3
$8N6795: LED3.1 LED4.3
$8N6805: LED4.1 LED5.3
$8N9148: R115.2 R116.1 U16.3
$8N11462: R126.1 TFT1.12
$10N1043: C248.2 RJ1.P1
$10N3488: R79.2 RJ1.12
$10N3497: R80.1 RJ1.13
$11N1789: C255.2 RJ2.P1
$11N1876: R97.2 RJ2.12
$11N1882: R98.1 RJ2.13
$12N612: D2.2 DC1.1 Q1.3
$12N673: Q1.1 R1.1 R2.2
$12N750: C3.2 DC1.5
$12N1163: C4.1 U3.1
$12N1491: C8.2 U3.4
$12N1559: C4.2 D4.2 L1.1 U3.8
$12N1618: C9.1 C10.1 U3.6
$12N1697: C9.2 R7.1
$12N1966: R3.1 R5.2
$12N2016: R5.1 R8.2 U3.5
$12N2052: R4.1 R6.2 U3.3
$12N3300: CN1.1 D1.1
$13N975: C245.2 R72.2 RF1.1
$13N1231: R76.1 U11.8
$13N1378: R77.1 R78.1
$13N1478: CN3.1 R77.2 U11.7
$13N1485: CN3.2 R78.2 U11.6
$13N1600: C238.2 R65.1
$13N1603: C241.2 R66.1
$13N2020: C242.2 R67.2
$13N2077: C243.2 R68.2
$13N5258: CGQ1.4 R125.1

Pads without a net: D12 5 6; D13 1 2 9 10; D14 1 2 9 10; DC1 4; FAN 1 2; FPC1 34 45 46 47 48 49; FPC2 1; LED5 1; TFT1 1 2 9; U4 2 3 4 5 36 40; U5 10; U8 A1 A2 A7 A8 A9 A10 A11 A12 A13 A14 B1 B7 B8 B9 B10 B11 B12 B13 B14 C1 C3 C5 C7 C8 C9 C10 C11 C12 C13 C14 D1 D2 D3 D4 D12 D13 D14 E1 E2 E3 E5 E8 E9 E10 E12 E13 E14 F1 F2 F3 F10 F12 F13 F14 G1 G2 G3 G10 G12 G13 G14 H1 H2 H3 H12 H13 H14 J1 J2 J3 J12 J13 J14 K1 K2 K3 K6 K7 K10 K12 K13 K14 L1 L2 L3 L12 L13 L14 M1 M2 M3 M7 M8 M9 M10 M11 M12 M13 M14 N1 N3 N6 N7 N8 N9 N10 N11 N12 N13 N14 P1 P2 P7 P8 P9 P10 P11 P12 P13 P14; U9 4 5 8 10 11 21 23 24 25 26 27 28 29 30 32 35 37 38 39 40; U14 A5 A8 A16 AA1 AA2 AA3 AA4 AA5 AA6 AB2 AB3 AC2 AC3 AC4 AC5 AC6 AD1 AD2 AE1 AE2 AE4 AE5 AE6 AG1 AG2 AG13 AG17 AH1 AH2 AH11 AH13 AH15 AJ1 AJ15 AK1 AK13 AK15 AK33 AL5 AL7 AL11 AL15 AL27 AL32 AL33 AM6 AM7 AM8 AM14 AM15 AM16 AM17 AM18 AM33 AN4 AN7 AN8 AN15 AN17 AN26 B6 B7 B8 B9 B15 C7 C9 C15 F20 G4 G16 J2 M3 N1 N4 N5 N31 N32 N33 U28 U29 U30 U33 W4 W5 W6 W29 Y2 Y3; UD1 A1 A2 A11 A12 AA1 AA12 AB1 AB2 AB11 AB12 B1 B12 G11 K5 K8 N5 N8; USB2 5 6 8 9

## Via types
v1: diameter 0.399, hole 0.299, Top Layer to Bottom Layer, 572 vias
v2: diameter 0.4, hole 0.3, Top Layer to Bottom Layer, 279 vias
v3: diameter 0.4, hole 0.299, Top Layer to Bottom Layer, 504 vias

## Routing (per net, layer and track width the routed paths; a pad name or vN(x,y) marks a point on that pad's centre or on a via; arc(x,y) is an arc through that point)
AGND: length 3.5
  Top Layer w0.152: v3(57.92,55.15) U14.AE3
  Bottom Layer w0.152: C110.1 57.99,55.08 v3(57.92,55.15) ; C110.1 C109.1 ; C110.1 58.52,54.64 C111.1 59.04,54.65 59.14,54.55 ; 59.14,54.55 C108.1 ; 59.14,54.55 R28.2
GND: length 1107.8
  Top Layer w0.076: v2(52.19,41.81) 52.07,41.68 48.72,41.68 45.64,44.75 45.64,45.06 43.54,47.16 36.65,47.16 36.63,47.18 36.33,47.18 v2(36.17,47.33) ; 68.45,49.61 68.67,49.39 69.04,49.39 69.22,49.21 69.97,49.21 v3(70.08,49.33) ; 68.44,43.64 68.69,43.4 69.05,43.4 69.2,43.25 arc(69.25,43.25) 69.29,43.24 arc(69.38,43.22) 69.47,43.22 arc(69.81,43.22) v3(70.16,43.18) ; 57.43,40.64 57.43,40.54 57.18,40.28 57.18,39.91 56.7,39.42 56.61,39.42 ; U14.C28 68.68,42.41 ; 68.68,42.41 68.68,42.41 ; 68.68,42.41 68.68,42.41 ; 68.68,42.41 68.69,42.16 68.68,41.88 U14.C30 ; v3(65.94,56.79) 65.8,56.66 65.8,55.88 65.69,55.77 65.69,55.39 65.44,55.14 ; 70.59,46.33 70.62,46.36 70.75,46.36 70.89,46.51 v3(71.09,46.51) ; 69.92,43.23 69.9,43.25 ; v3(70.24,47.41) 70.03,47.41 69.84,47.23 69.22,47.23 69.05,47.39 68.69,47.39 68.44,47.64 ; v3(64.08,38.86) 64.25,39.32 64.23,39.66 64.28,39.81 64.44,40.14 ; 52.55,51.2 52.45,51.3 52.45,51.77 52.65,51.97 52.96,51.97 53.28,51.65 U14.AN10 ; 53.07,46.89 53.68,46.89 53.93,46.64 ; v1(72.31,44.22) 72.29,44.25 71.05,44.25 ; 63.4,56.72 63.2,56.52 63.2,55.38 63.44,55.14 ; UD1.N4 40.1,47.82 ; UD1.N4 39.59,47.82 ; UD1.N4 v2(40.23,48.43) ; 40.1,47.82 39.59,47.82 ; 40.1,47.82 43.69,47.82 43.86,47.84 46.4,45.29 46.4,45.06 48.99,42.47 51.59,42.47 51.66,42.54 52.73,42.54 52.74,42.53 v2(52.79,42.53) ; 56.43,40.28 56.68,40.53 56.68,40.89 56.43,41.14 ; v2(49.07,45.47) 49.43,45.8 50.57,45.8 v2(50.8,45.47) ; 68.69,51.39 68.69,51.39 68.69,50.89 U14.C12 ; 68.69,51.39 69.64,51.39 69.82,51.58 ; 68.69,51.39 68.44,51.64 ; 59.44,40.65 59.68,40.93 59.69,41.28 v2(59.9,41.59) ; v2(37.06,48.41) 37.51,47.82 39.59,47.82 ; 68.44,52.64 68.69,52.89 69.91,52.89 70.49,53.47 v1(73.53,53.47) ; 68.44,52.64 U14.C8 ; 68.44,52.64 68.69,52.39 68.69,51.9 U14.C10 ; 64.85,57.33 64.77,57.26 64.77,56.45 64.87,56.35 64.87,55.94 64.7,55.77 64.7,55.38 64.45,55.13 ; 36.91,36.04 36.91,35.62 U8.N2 ; 56.43,40.14 56.35,40.14 56.19,39.98 56.18,39.98 55.93,39.73 55.12,39.73 54.46,39.06 v2(54.46,39.01) ; 53.93,43.64 53.68,43.39 53.01,43.39 ; 62.43,55.18 62.19,55.42 62.19,55.7 62.21,55.9 62.2,56.07 62.2,56.13 62.23,56.37 v3(62.2,56.85) 62.2,56.85 62.2,57.01 ; U14.A32 69.31,40.65 69.06,40.89 68.69,40.89 U14.C31 ; 54.51,39.85 54.68,40.03 54.68,40.39 54.93,40.64 ; 53.93,42.14 53.68,41.89 53.33,41.89 53.33,41.89 53.25,41.81 52.98,41.81 ; 68.47,44.62 arc(68.72,44.46) 69,44.39 arc(69.04,44.39) 69.07,44.39 69.22,44.24 70.09,44.24 arc(70.22,44.24) 70.36,44.24 70.64,44.24 arc(70.67,44.24) 70.7,44.23 arc(70.87,44.22) 71.04,44.23
  Top Layer w0.102: v3(47.45,19.76) D5.8 ; C101.1 51.23,55.16 51.23,54.22 51.26,54.2 51.54,54.2 52.04,53.69 52.04,51.48 52.32,51.2 52.55,51.2 52.65,51.1 53.4,51.1 U14.AN11 ; v2(48.36,47.8) 49.91,47.8 49.98,47.73 51.74,47.73 ; v1(36.91,36.6) 36.91,36.04 ; 51.33,44.29 51.36,44.29 51.45,44.38 52.4,44.38 52.8,44.78 v2(52.91,44.78) ; C100.1 51.35,52.31 51.36,52.3 ; R34.1 v3(59.23,59.82) ; v3(47.45,21.79) D5.3 ; v3(51.64,50.72) 51.64,50.97 51.36,51.25 ; v3(66.95,55.14) 67.44,55.14 ; 51.36,52.3 arc(51.36,52.39) 51.36,52.48 arc(51.36,52.91) 51.36,53.34 ; 51.36,52.3 arc(51.36,51.77) 51.36,51.25 ; v3(44.75,19.63) 44.58,19.81 D6.8 D6.3 v3(44.58,21.79) ; X3.4 61.73,22.64 C252.1 62.67,22.64 v3(62.76,22.56) ; 51.36,51.25 C99.1 50.53,51.02 X1.4 ; v3(57.56,59.79) R35.1 R33.1 ; 66.95,55.15 U14.G3 ; v2(56.07,39) 56.07,39.05 56.44,39.42 56.61,39.42 ; 56.43,40.28 56.43,40.14